# EasyEDA Pro project Athena.eprj, board PCB (continued)
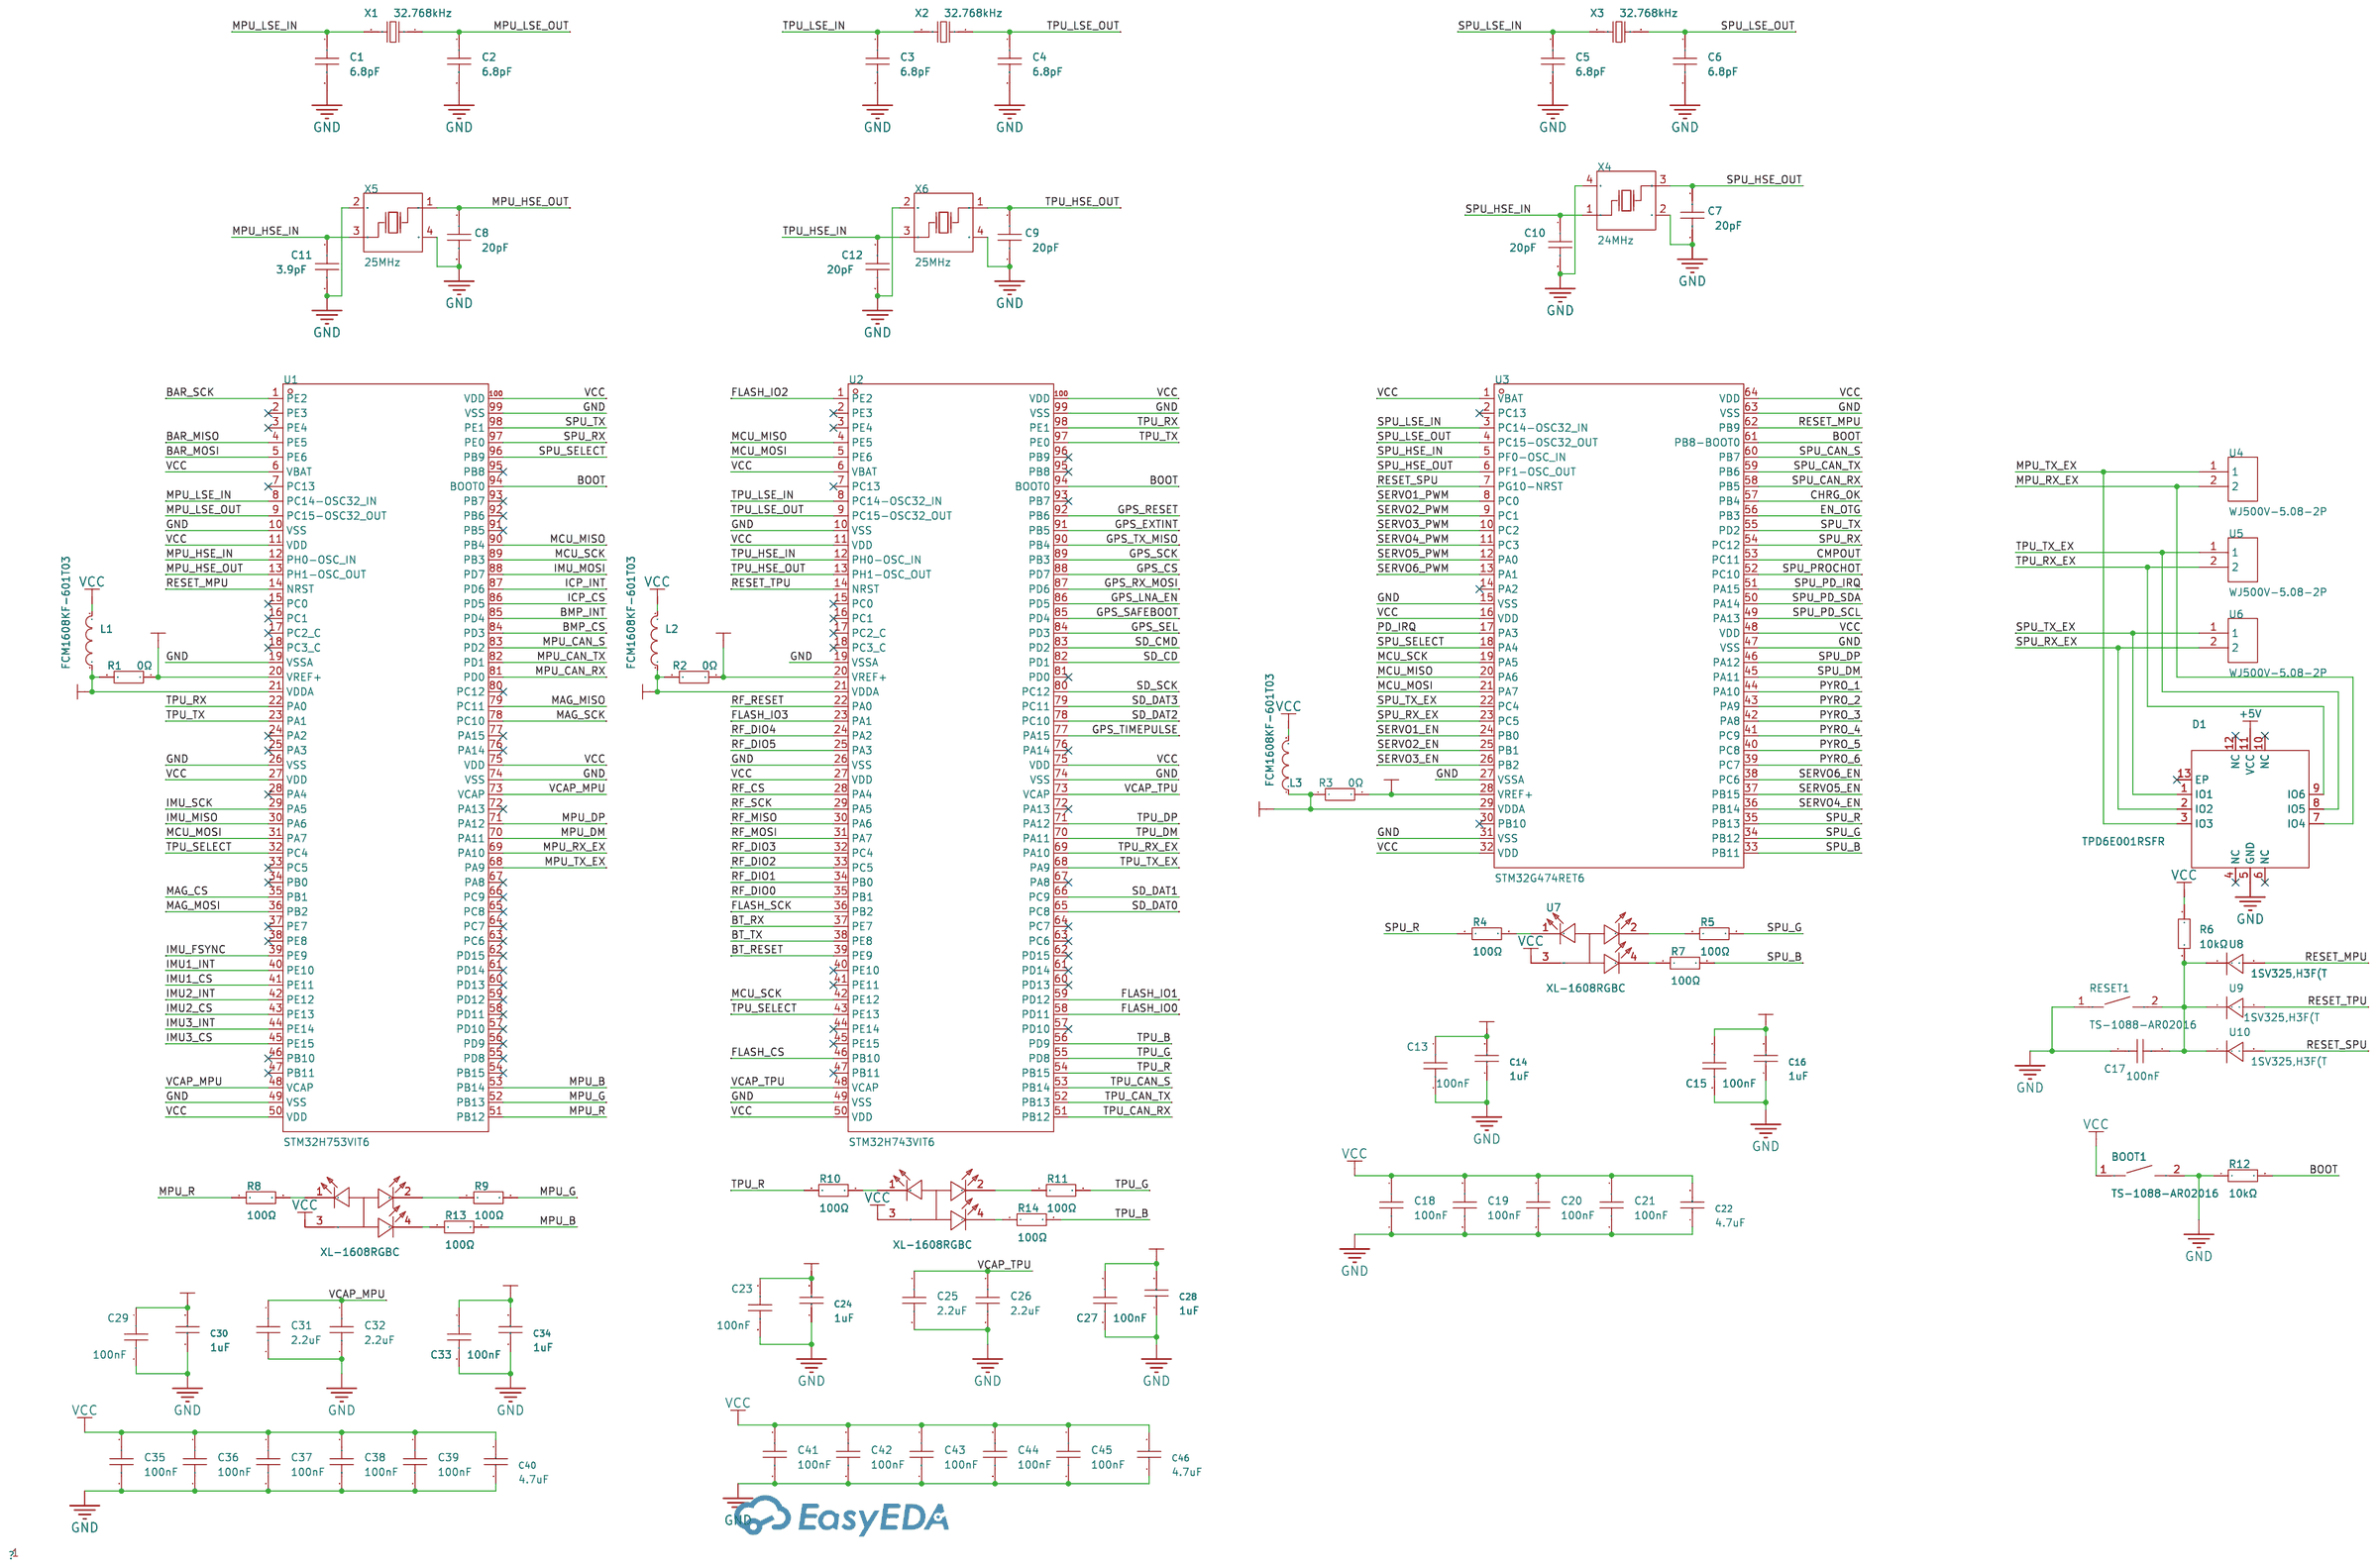
[diagram p0: Processors]
## Footprints (pads in the part's own frame, mm; a bottom-side part is the same pattern mirrored in y, then rotated)
C0402
  rect 0.79x0.54 smd: 1(-0.545,0) 2(0.545,0)
C0603
  rect 0.8x0.9 smd: 1(-0.7,0) 2(0.7,0)
C0805
  rect 1.41x1.35 smd: 1(-1,0) 2(1,0)
C1210
  rect 1.635x2.7 smd: 1(-1.518,0) 2(1.518,0)
CONN-TH_2P-P5.00_WJ500V-5.08-2P
  round 2 hole 1.3: 1(-2.54,0) 2(2.54,0)
CRYSTAL-SMD_4P-L3.2-W2.5-BL
  rect 1.4x1.2 smd: 1(-1.1,-0.85) 2(1.1,-0.85) 3(1.1,0.85) 4(-1.1,0.85)
F0603
  rect 0.806x0.864 smd: 1(-0.753,0) 2(0.753,0)
FC-135R_L3.2-W1.5
  rect 1x1.8 smd: 1(-1.25,0) 2(1.25,0)
GPSM-SMD_24P-L16.0-W12.2-P1.10-TL
  rect 1.8x0.8 smd: 1(-6.1,7) 2(-6.1,5.9) 3(-6.1,4.8) 4(-6.1,3.7) 5(-6.1,2.6) 6(-6.1,1.5) 7(-6.1,0.4) 8(-6.1,-2.6) 9(-6.1,-3.7) 10(-6.1,-4.8) 11(-6.1,-5.9) 12(-6.1,-7) 13(6.1,-7) 14(6.1,-5.9) 15(6.1,-4.8) 16(6.1,-3.7) 17(6.1,-2.6) 18(6.1,0.4) 19(6.1,1.5) 20(6.1,2.6) 21(6.1,3.7) 22(6.1,4.8) 23(6.1,5.9) 24(6.1,7)
HDR-TH_3P-P2.54-V-M
  rect 1.7x1.7 hole 1.1: 1(-2.54,0)
  round 1.7 hole 1.1: 2(0,0) 3(2.54,0)
IND-SMD_L4.4-W4.2
  rect 1.4x2.12 smd: 1(2.028,0) 2(-2.028,0)
IND-SMD_L11.5-W10.0_104CDMCCDS
  rect 3.5x4.1 smd: 1(-5.2,0) 2(5.2,0)
L0402-RD
  rect 0.79x0.54 smd: 1(-0.545,0) 2(0.545,0)
L0603
  rect 0.8x0.864 smd: 1(-0.7,0) 2(0.7,0)
L1206
  rect 1.485x1.728 smd: 1(-1.593,0) 2(1.593,0)
LED0402-RD
  rect 0.636x0.54 smd: 1(-0.538,0) 2(0.538,0)
LED-SMD_4P-L1.6-W0.8-BL
  rect 0.5x0.4 smd: 1(-0.6,0.35) 2(0.6,0.35) 3(-0.6,-0.35) 4(0.6,-0.35)
LGA-10_L2.0-W2.0-P0.50-TL_ICP-20100
  rect 0.3x0.3 smd: 1(-0.78,0.25) 2(-0.78,-0.25) 3(-0.5,-0.78) 4(0,-0.78) 5(0.5,-0.78) 6(0.78,-0.25) 7(0.78,0.25) 8(0.5,0.78) 9(0,0.78) 10(-0.5,0.78)
LGA-12_L2.0-W2.0-P0.50-BL
  rect 0.28x0.5 smd: 1(-0.75,-0.875) 2(-0.25,-0.875) 3(0.25,-0.875) 4(0.75,-0.875) 7(0.75,0.875) 8(0.25,0.875) 9(-0.25,0.875) 10(-0.75,0.875)
  rect 0.5x0.28 smd: 5(0.875,-0.25) 6(0.875,0.25) 11(-0.875,0.25) 12(-0.875,-0.25)
LGA-14_L3.0-W2.5-P0.50-TL
  rect 0.675x0.28 smd: 1(-1.262,0.75) 2(-1.262,0.25) 3(-1.262,-0.25) 4(-1.262,-0.75) 8(1.262,-0.75) 9(1.262,-0.25) 10(1.262,0.25) 11(1.262,0.75)
  rect 0.28x0.675 smd: 5(-0.5,-1.012) 6(0,-1.012) 7(0.5,-1.012) 12(0.5,1.012) 13(0,1.012) 14(-0.5,1.012)
LQFP-32_L7.0-W7.0-P0.80-LS9.0-BL
  oval 0.448x1.684 smd: 1(-2.8,-4.242) 2(-2,-4.242) 3(-1.2,-4.242) 4(-0.4,-4.242) 5(0.4,-4.242) 6(1.2,-4.242) 7(2,-4.242) 8(2.8,-4.242) 17(2.8,4.242) 18(2,4.242) 19(1.2,4.242) 20(0.4,4.242) 21(-0.4,4.242) 22(-1.2,4.242) 23(-2,4.242) 24(-2.8,4.242)
  oval 1.684x0.448 smd: 9(4.242,-2.8) 10(4.242,-2) 11(4.242,-1.2) 12(4.242,-0.4) 13(4.242,0.4) 14(4.242,1.2) 15(4.242,2) 16(4.242,2.8) 25(-4.242,2.8) 26(-4.242,2) 27(-4.242,1.2) 28(-4.242,0.4) 29(-4.242,-0.4) 30(-4.242,-1.2) 31(-4.242,-2) 32(-4.242,-2.8)
LQFP-64_L10.0-W10.0-P0.50-LS12.0-BL
  oval 0.3x2 smd: 1(-3.75,-5.75) 2(-3.25,-5.75) 3(-2.75,-5.75) 4(-2.25,-5.75) 5(-1.75,-5.75) 6(-1.25,-5.75) 7(-0.75,-5.75) 8(-0.25,-5.75) 9(0.25,-5.75) 10(0.75,-5.75) 11(1.25,-5.75) 12(1.75,-5.75) 13(2.25,-5.75) 14(2.75,-5.75) 15(3.25,-5.75) 16(3.75,-5.75) 33(3.75,5.75) 34(3.25,5.75) 35(2.75,5.75) 36(2.25,5.75) 37(1.75,5.75) 38(1.25,5.75) 39(0.75,5.75) 40(0.25,5.75) 41(-0.25,5.75) 42(-0.75,5.75) 43(-1.25,5.75) 44(-1.75,5.75) 45(-2.25,5.75) 46(-2.75,5.75) 47(-3.25,5.75) 48(-3.75,5.75)
  oval 2x0.3 smd: 17(5.75,-3.75) 18(5.75,-3.25) 19(5.75,-2.75) 20(5.75,-2.25) 21(5.75,-1.75) 22(5.75,-1.25) 23(5.75,-0.75) 24(5.75,-0.25) 25(5.75,0.25) 26(5.75,0.75) 27(5.75,1.25) 28(5.75,1.75) 29(5.75,2.25) 30(5.75,2.75) 31(5.75,3.25) 32(5.75,3.75) 49(-5.75,3.75) 50(-5.75,3.25) 51(-5.75,2.75) 52(-5.75,2.25) 53(-5.75,1.75) 54(-5.75,1.25) 55(-5.75,0.75) 56(-5.75,0.25) 57(-5.75,-0.25) 58(-5.75,-0.75) 59(-5.75,-1.25) 60(-5.75,-1.75) 61(-5.75,-2.25) 62(-5.75,-2.75) 63(-5.75,-3.25) 64(-5.75,-3.75)
LQFP-100_L14.0-W14.0-P0.50-LS16.0-BL
  oval 0.3x1.6 smd: 1(-6,-7.55) 2(-5.5,-7.55) 3(-5,-7.55) 4(-4.5,-7.55) 5(-4,-7.55) 6(-3.5,-7.55) 7(-3,-7.55) 8(-2.5,-7.55) 9(-2,-7.55) 10(-1.5,-7.55) 11(-1,-7.55) 12(-0.5,-7.55) 13(0,-7.55) 14(0.5,-7.55) 15(1,-7.55) 16(1.5,-7.55) 17(2,-7.55) 18(2.5,-7.55) 19(3,-7.55) 20(3.5,-7.55) 21(4,-7.55) 22(4.5,-7.55) 23(5,-7.55) 24(5.5,-7.55) 25(6,-7.55) 51(6,7.55) 52(5.5,7.55) 53(5,7.55) 54(4.5,7.55) 55(4,7.55) 56(3.5,7.55) 57(3,7.55) 58(2.5,7.55) 59(2,7.55) 60(1.5,7.55) 61(1,7.55) 62(0.5,7.55) 63(0,7.55) 64(-0.5,7.55) 65(-1,7.55) 66(-1.5,7.55) 67(-2,7.55) 68(-2.5,7.55) 69(-3,7.55) 70(-3.5,7.55) 71(-4,7.55) 72(-4.5,7.55) 73(-5,7.55) 74(-5.5,7.55) 75(-6,7.55)
  oval 1.6x0.3 smd: 26(7.55,-6) 27(7.55,-5.5) 28(7.55,-5) 29(7.55,-4.5) 30(7.55,-4) 31(7.55,-3.5) 32(7.55,-3) 33(7.55,-2.5) 34(7.55,-2) 35(7.55,-1.5) 36(7.55,-1) 37(7.55,-0.5) 38(7.55,0) 39(7.55,0.5) 40(7.55,1) 41(7.55,1.5) 42(7.55,2) 43(7.55,2.5) 44(7.55,3) 45(7.55,3.5) 46(7.55,4) 47(7.55,4.5) 48(7.55,5) 49(7.55,5.5) 50(7.55,6) 76(-7.55,6) 77(-7.55,5.5) 78(-7.55,5) 79(-7.55,4.5) 80(-7.55,4) 81(-7.55,3.5) 82(-7.55,3) 83(-7.55,2.5) 84(-7.55,2) 85(-7.55,1.5) 86(-7.55,1) 87(-7.55,0.5) 88(-7.55,0) 89(-7.55,-0.5) 90(-7.55,-1) 91(-7.55,-1.5) 92(-7.55,-2) 93(-7.55,-2.5) 94(-7.55,-3) 95(-7.55,-3.5) 96(-7.55,-4) 97(-7.55,-4.5) 98(-7.55,-5) 99(-7.55,-5.5) 100(-7.55,-6)
OSC-SMD_4P-L7.0-W5.0-BL_ABMM
  rect 1.9x1.4 smd: 1(-3.15,-1.27) 2(3.15,-1.27) 3(3.15,1.27) 4(-3.15,1.27)
PICOSTAR-3_L0.7-W0.6-P0.35-TL
  rect 0.3x0.2 smd: 1(-0.225,0.202) 2(-0.225,-0.202)
  rect 0.2x0.6 smd: 3(0.225,-0.002)
PICOSTAR-3_L0.7-W0.6-P0.40-TL
  rect 0.25x0.2 smd: 1(-0.2,0.2) 2(-0.2,-0.2)
  rect 0.15x0.5 smd: 3(0.2,0)
POWERVDFN-8_L6.0-W5.0-P1.27-BL
  rect 0.8x1.321 smd: 1(-1.905,-3.026) 2(-0.635,-3.026) 3(0.635,-3.026) 4(1.905,-3.026) 5(1.905,3.026) 6(0.635,3.026) 7(-0.635,3.026) 8(-1.905,3.026)
  rect 4.6x3.6 smd: 9(0,0.65)
QFN-12_L4.0-W4.0-P0.80-BL-EP1.7
  rect 0.35x0.8 smd: 1(-0.8,-1.9) 2(0,-1.9) 3(0.8,-1.9) 7(0.8,1.9) 8(0,1.9) 9(-0.8,1.9)
  rect 0.8x0.35 smd: 4(1.9,-0.8) 5(1.9,0) 6(1.9,0.8) 10(-1.9,0.8) 11(-1.9,0) 12(-1.9,-0.8)
  rect 1.7x1.7 smd: 13(0,0)
QFN-32_L4.0-W4.0-P0.40-TL-EP2.8
  oval 0.7x0.2 smd: 1(-2.057,1.4) 2(-2.057,1) 3(-2.057,0.6) 4(-2.057,0.2) 5(-2.057,-0.2) 6(-2.057,-0.6) 7(-2.057,-1) 8(-2.057,-1.4) 17(2.057,-1.4) 18(2.057,-1) 19(2.057,-0.6) 20(2.057,-0.2) 21(2.057,0.2) 22(2.057,0.6) 23(2.057,1) 24(2.057,1.4)
  oval 0.2x0.7 smd: 9(-1.4,-2.057) 10(-1,-2.057) 11(-0.6,-2.057) 12(-0.2,-2.057) 13(0.2,-2.057) 14(0.6,-2.057) 15(1,-2.057) 16(1.4,-2.057) 25(1.4,2.057) 26(1,2.057) 27(0.6,2.057) 28(0.2,2.057) 29(-0.2,2.057) 30(-0.6,2.057) 31(-1,2.057) 32(-1.4,2.057)
  rect 2.8x2.8 smd: 33(0,-0.001)
QFN-38_L6.0-W4.0-P0.40-TL-EP_TI_REF0038A
  rect 0.6x0.2 smd: 1(-2.9,1) 2(-2.9,0.6) 3(-2.9,0.2) 4(-2.9,-0.2) 5(-2.9,-0.6) 6(-2.9,-1)
  rect 0.2x0.6 smd: 7(-2.4,-1.9) 8(-2,-1.9) 9(-1.6,-1.9) 10(-1.2,-1.9) 11(-0.8,-1.9) 12(-0.4,-1.9) 13(0,-1.9) 14(0.4,-1.9) 15(0.8,-1.9) 16(1.2,-1.9) 17(1.6,-1.9) 18(2,-1.9) 19(2.4,-1.9) 26(2.4,1.9) 27(2,1.9) 28(1.6,1.9) 29(1.2,1.9) 30(0.8,1.9) 31(0.4,1.9) 36(-1.6,1.9) 37(-2,1.9) 38(-2.4,1.9)
  custom 0.6x1.12 smd: 21(2.9,-0.675) 24(2.9,0.675)
  custom 0.6x0.6 smd: 32(-0.2,1.9) 34(-1,1.9)
  rect 2.65x2.65 smd: 39(-0.965,0)
  rect 1.53x2.65 smd: 40(1.56,0)
R0402
  rect 0.566x0.54 smd: 1(-0.433,0) 2(0.433,0)
R0603
  rect 0.806x0.864 smd: 1(-0.753,0) 2(0.753,0)
R1206
  rect 1.208x1.701 smd: 1(-1.479,0) 2(1.479,0)
SENSORM-SMD_BMP388
  rect 0.3x0.5 smd: 1(0.25,0.871) 2(-0.25,0.871) 6(-0.25,-0.871) 7(0.25,-0.871)
  rect 0.5x0.3 smd: 3(-0.869,0.5) 4(-0.869,0) 5(-0.869,-0.5) 8(0.869,-0.5) 9(0.869,0) 10(0.869,0.5)
SMA-TH_BWSMA-KWE-Z001
  round 2.2 hole 1.6: 1(-2.55,-2.55) 2(-2.55,2.55) 3(2.55,2.55) 4(2.55,-2.55)
  round 2 hole 1.3: 5(0,0)
SOD-523_L1.2-W0.8-LS1.6-RD
  rect 0.6x0.36 smd: 1(-0.65,0) 2(0.65,0)
SOIC-8_L4.9-W3.9-P1.27-LS6.0-BL
  oval 0.588x2.045 smd: 1(-1.905,-2.772) 2(-0.635,-2.772) 3(0.635,-2.772) 4(1.905,-2.772) 5(1.905,2.772) 6(0.635,2.772) 7(-0.635,2.772) 8(-1.905,2.772)
SOT-23-3_L2.9-W1.3-P1.90-LS2.4-BR
  rect 1.25x0.7 smd: 1(1,-0.95) 2(1,0.95) 3(-1,0)
SOT-23-3_L2.9-W1.6-P1.90-LS2.8-BR
  rect 1.07x0.6 smd: 1(1.235,-0.95) 2(1.235,0.95) 3(-1.235,0)
SOT-23-3_L3.0-W1.7-P0.95-LS2.9-BR
  rect 1.038x0.532 smd: 1(1.101,-0.95) 2(1.101,0.95) 3(-1.101,0)
SOT-23-6_L2.9-W1.6-P0.95-LS2.8-BL
  rect 0.532x1.072 smd: 1(-0.95,-1.149) 2(0,-1.149) 3(0.95,-1.149) 4(0.95,1.149) 5(0,1.149) 6(-0.95,1.149)
SW-SMD_L3.9-W3.0-P4.45
  rect 1.23x1.36 smd: 1(-2.185,0) 2(2.185,0)
TF-SMD_TF-PUSH
  rect 0.7x1.6 smd: 1(2.25,5.3) 2(1.15,5.3) 3(0.05,5.3) 4(-1.05,5.3) 5(-2.15,5.3) 6(-3.25,5.3) 7(-4.35,5.3) 8(-5.45,5.3) CD(-6.55,5.3)
  rect 1.2x1.5 smd: 10(-7.75,4.3)
  rect 1.2x2.2 smd: 11(-7.75,-5.3) 12(7.75,-5.3)
  rect 1.6x1.5 smd: 13(6.85,4.3)
USB-C-SMD_TYPE-C-6PIN-2MD-073
  rect 0.55x1.1 smd: 1(-3.2,2.375) 2(-2.4,2.375) 11(2.4,2.375) 12(3.2,2.375)
  rect 0.3x1.1 smd: 3(-1.75,2.375) 4(-1.25,2.375) 5(-0.75,2.375) 6(-0.25,2.375) 7(0.25,2.375) 8(0.75,2.375) 9(1.25,2.375) 10(1.75,2.375)
  oval 1.1x2 hole 0.6x1.5: 13(-4.325,1.825) 14(4.325,1.825)
  oval 1.2x1.8 hole 0.6x1.2: 13(-4.325,-2.375) 14(4.325,-2.375)
VQFN-20_L4.5-W3.5-P0.50-BL-EP
  rect 0.85x0.28 smd: 1(-2.25,-0.752) 10(2.25,-0.752) 11(2.25,0.748) 20(-2.25,0.75)
  rect 0.28x0.85 smd: 2(-1.748,-1.75) 3(-1.248,-1.75) 4(-0.749,-1.75) 5(-0.248,-1.75) 6(0.252,-1.75) 7(0.751,-1.75) 8(1.252,-1.75) 9(1.752,-1.75) 12(1.752,1.75) 13(1.252,1.75) 14(0.75,1.748) 15(0.25,1.748) 16(-0.25,1.748) 17(-0.75,1.748) 18(-1.25,1.748) 19(-1.75,1.748)
  rect 2.7x1.7 smd: 21(0,-0.002)
VSON-CLIP-8_L3.3-W3.3-P0.65-BL
  rect 0.4x0.7 smd: 1(-0.975,-1.6) 2(-0.325,-1.6) 3(0.325,-1.6) 4(0.975,-1.6) 5(0.975,1.6) 6(0.325,1.6) 7(-0.325,1.6) 8(-0.975,1.6)
  rect 2.45x1.9 smd: 8(0,0.44)
VSONP-8_L3.1-W3.1-P0.65-LS3.5-BL
  rect 0.45x0.68 smd: 1(-0.988,-1.498) 2(-0.338,-1.498) 3(0.312,-1.498) 4(0.963,-1.498)
  rect 0.5x0.6 smd: 5(0.988,1.498) 6(0.338,1.498) 7(-0.312,1.498) 8(-0.963,1.498)
  rect 2.65x2 smd: 9(0.013,0.406)
WIRELM-SMD-16_L14.5-W12.5-P1.50-DA14531MOD
  rect 2.6x1.2 smd: J1(-6.088,4.044) J2(-6.088,2.544) J3(-6.088,1.044) J4(-6.088,-0.457) J5(-6.088,-1.956) J12(6.088,-1.956) J13(6.088,-0.457) J14(6.088,1.044) J15(6.088,2.544) J16(6.088,4.044)
  rect 1.2x2.6 smd: J6(-3.75,-4.043) J7(-2.25,-4.043) J8(-0.75,-4.043) J9(0.75,-4.043) J10(2.25,-4.043) J11(3.75,-4.043)
WIRELM-SMD_RA-02-BL
  rect 1.4x2.2 smd: 1(-7,-8) 2(-5,-8) 3(-3,-8) 4(-1,-8) 5(1,-8) 6(3,-8) 7(5,-8) 8(7,-8) 9(7,8) 10(5,8) 11(3,8) 12(1,8) 13(-1,8) 14(-3,8) 15(-4.998,8) 16(-7,8)
WQFN-20_L3.0-W3.0-P0.40-BL-EP1.7
  rect 0.2x0.8 smd: 1(-0.8,-1.5) 2(-0.4,-1.5) 3(0,-1.5) 4(0.4,-1.5) 5(0.8,-1.5) 11(0.8,1.5) 12(0.4,1.5) 13(0,1.5) 14(-0.4,1.5) 15(-0.8,1.5)
  rect 0.8x0.2 smd: 6(1.5,-0.8) 7(1.5,-0.4) 8(1.5,0) 9(1.5,0.4) 10(1.5,0.799) 16(-1.5,0.8) 17(-1.5,0.4) 18(-1.5,0) 19(-1.5,-0.4) 20(-1.5,-0.8)
  rect 1.7x1.7 smd: 21(0,0)
WSON-8_L8.0-W6.10-P1.27-BL-EP
  oval 0.56x1.4 smd: 1(-1.905,-4.027) 2(-0.635,-4.027) 3(0.635,-4.027) 4(1.905,-4.027) 5(1.905,4.027) 6(0.635,4.027) 7(-0.635,4.027) 8(-1.905,4.027)
  rect 4.3x3.4 smd: 9(0,0)

## Nets
As in the schematic, except:
GND: BOOT1.2 C1.2 C2.2 C3.2 C4.2 C5.2 C6.2 C7.2 C8.2 C9.2 C10.2 C11.2 C12.2 C13.2 C14.1 C15.2 C16.1 C17.2 C18.2 C19.2 C20.2 C21.2 C22.1 C23.2 C24.1 C25.2 C26.2 C27.2 C28.1 C29.2 C30.1 C31.2 C32.2 C33.2 C34.1 C35.2 C36.2 C37.2 C38.2 C39.2 C40.1 C41.2 C42.2 C43.2 C44.2 C45.2 C46.1 C47.1 C48.1 C50.1 C51.1 C52.1 C54.1 C55.1 C59.2 C60.2 C61.2 C62.2 C69.2 C81.1 C82.1 C83.1 C84.2 C86.2 C87.2 C88.2 C89.2 C90.2 C91.2 C92.2 C93.2 C94.2 C95.2 C96.2 C97.2 C98.2 C99.2 C100.2 C101.2 C102.2 C103.2 C104.2 C105.2 C106.2 C107.2 C108.2 C109.2 C110.2 C111.2 C112.2 C113.2 C114.2 C115.2 C116.2 C117.2 C118.2 C119.2 C120.2 C121.2 C122.2 C123.2 C124.2 C125.1 C126.1 C127.2 C128.2 C129.1 C130.2 C131.2 C132.1 C133.2 C134.2 C135.2 C136.1 C137.2 C138.2 C139.2 CARD1.6 CARD1.10 CARD1.11 CARD1.12 CARD1.13 D1.5 D2.8 D2.13 D2.18 D2.21 D3.3 F1.2 F2.2 F3.2 F4.2 F5.2 F6.2 FLASH1.4 FLASH1.9 GPS1.7 GPS1.10 GPS1.12 GPS1.13 GPS1.24 IMU1.6 IMU2.6 IMU3.6 MAG1.3 Q2.1 Q2.2 Q2.3 Q5.2 Q6.2 R12.1 R16.1 R17.1 R23.1 R30.1 R41.1 R47.2 R51.2 R52.2 R53.1 R65.1 R86.1 R87.1 R89.1 R91.1 R93.1 R94.1 RESET1.1 RF1.1 RF1.2 RF1.3 RF1.4 S1.1 S2.1 S3.1 S4.1 S5.1 S6.1 U1.10 U1.19 U1.26 U1.49 U1.74 U1.99 U2.10 U2.19 U2.26 U2.49 U2.74 U2.99 U3.15 U3.27 U3.31 U3.47 U3.63 U13.6 U13.12 U13.21 U15.2 U17.1 U18.2 U19.14 U19.33 U20.11 U20.12 U20.14 U20.39 U21.J2 U21.J3 U21.J4 U21.J6 U21.J11 U22.2 U23.7 U23.21 U23.22 U23.23 U23.24 U23.28 U23.31 U23.32 U24.1 U24.2 U24.9 U24.16 U25.2 U26.2 U27.3 U27.8 U27.9 U28.6 U28.8 USB1.1 USB1.12 USB1.13 USB1.14 X4.2 X4.4 X5.2 X5.4 X6.2 X6.4 X7.2 X7.4

Pads without a net: D1 4 6 10 12 13; D2 16 17; GPS1 5 6 15 16 17; IMU1 2 3 7 10 11; IMU2 2 3 7 10 11; IMU3 2 3 7 10 11; MAG1 8 9; U1 2 3 7 15 16 17 18 24 25 28 33 34 37 38 46 47 54 55 56 57 58 59 60 61 62 63 64 65 66 67 72 76 77 80 91 92 93 95; U2 2 3 7 15 16 17 18 40 41 44 45 47 57 60 61 62 63 64 67 72 76 81 93 95 96; U3 2 14 30; U13 7 9 15 16; U20 5 6 7 13 19 36 37; U21 J1 J5 J8 J9 J13 J15 J16; U23 5 9 13 17; U28 2 11 12

## Via types
v1: diameter 0.4, hole 0.2, Top Layer to Bottom Layer, 1561 vias
v2: diameter 0.4, hole 0.3, Top Layer to Bottom Layer, 19 vias
v3: diameter 0.6, hole 0.4, Top Layer to Bottom Layer, 6 vias

## Routing (per net, layer and track width the routed paths; a pad name or vN(x,y) marks a point on that pad's centre or on a via; arc(x,y) is an arc through that point)
5V_COMP: length 5.8
  Bottom Layer w0.2: 23.5,24.56 26.94,24.56 27.12,24.39 27.12,24.29 27.31,24.48 C57.1
5V_FB: length 14.3
  Bottom Layer w0.2: U13.5 24.29,24.06 26.27,22.08 29.32,22.08 30.32,23.08 R24.2
  Bottom Layer w0.4: R24.2 30.52,24.09 C57.2 30.44,24.78 30.44,26.96 C53.2 30.43,28.17 R18.1
5V_VCC: length 12.7
  SIGNAL w0.2: v1(25.6,21.7) 20.15,21.7 v1(18.77,23.08)
  Bottom Layer w0.2: v1(25.6,21.7) 26.25,21.05 R20.1 R21.1 ; U13.14 18.72,23.06 ; 18.72,23.06 17.53,23.06 C55.2 ; 18.72,23.06 18.74,23.08 v1(18.77,23.08)
+5V: length 142.9
  Top Layer w0.4: v2(47.25,12.95) Q15.2 ; v2(29.45,57.05) 29.6,56.9 C121.1 29.6,54.4 U26.3 ; v2(50.55,12.95) Q16.2 ; Q17.2 53.8,10.95 v2(53.8,8.75) ; v2(49.35,57.05) 49.41,56.99 C119.1 49.41,54.4 U25.3 ; U22.3 39.41,54.4 C112.1 39.41,57.04 v2(39.4,57.05)
  POWER w0.4: v1(28.75,30.15) 24.93,30.15 24.92,30.16 ; 24.92,30.16 24.92,52.52 v2(29.45,57.05) ; 24.92,30.16 v2(24.92,16.3) ; v2(29.45,57.05) 20.15,66.35 v2(20.15,70.1) ; v2(29.45,57.05) v2(39.4,57.05) v2(49.35,57.05)
  GND2 w0.4: v2(53.8,8.75) 53.8,12.85 53.7,12.95 v2(50.55,12.95) v2(47.25,12.95) 41.12,12.95 39.27,11.1 v2(22.95,11.1) v2(22.2,11.1) v2(21.46,11.1)
  Bottom Layer w0.4: v2(20.15,70.1) 19.35,70.9 D1.11 ; v1(28.75,30.15) 29.95,30.15 R18.2 31.75,30.03 R19.2
  vias: v1(12,14.9) v1(12.75,14.9) v1(13.5,14.9) v1(13.5,11.8) v1(14.25,14.9) v1(14.25,11.8) v1(15,14.9) v1(15,11.8) v1(15.75,14.9) v1(15.75,11.8) v1(16.5,14.9) v1(16.5,11.8) v1(17.25,14.9) v1(17.25,11.8) v1(18,14.9) v1(18,11.8) v1(18.75,14.9) v1(18.75,11.8) v1(19.35,15.25) v1(19.5,11.8) v1(19.88,15.78) v1(20.25,11.8) v1(20.42,16.3) v1(21,11.8) v1(21.17,16.3) v1(21.92,16.3) v1(22.67,16.3) v1(23.42,16.3) v1(24.17,16.3) v1(25.67,16.3) v1(26.42,16.3) v1(27.17,16.3) v1(27.92,16.3) v1(28.67,16.3) v1(48,37.3) v1(48.9,37.3) v1(49.8,37.3) v1(50.7,37.3) v1(51.7,37.3) v1(52.7,37.3) v1(53.6,37.3) v1(56.12,37.7) v1(56.39,37.2) v1(56.63,37.7) v1(56.89,37.2) v1(57.2,37.7) v1(57.4,37.2) v1(57.7,37.7)
AGND: length 17.8
  GND2 w0.4: v1(32.5,45.4) 32.5,46.9 31.05,48.35 25.87,48.35 v1(21.8,52.43)
  Bottom Layer w0.2: U19.27 32.66,45.24 v1(32.5,45.4) C85.2
  Bottom Layer w0.4: v1(21.8,52.43) 22.94,52.43 Q11.1
GND: length 45.4
  Top Layer w0.2: 6.49,47.24 D3.3 ; 6.49,47.24 C123.2 ; 6.49,47.24 5.52,48.22 ; U2.99 30.93,81.42 31.41,80.94 32.14,80.94 32.6,81.4 v1(32.95,81.4) ; 51.27,84.63 50.45,85.45
  Bottom Layer w0.2: U13.12 20.26,22.06 v1(21.1,22.9) ; 62.85,37.02 62.05,37.02 ; 62.85,37.02 62.89,37.02 63.01,36.9 63.37,36.9 U20.11 ; 62.85,37.02 U20.12 ; 62.05,37.02 62.86,36.21 62.86,35.85 63.01,35.7 63.37,35.7 U20.14 ; 62.05,37.02 v1(61.51,37.02) ; v1(64.85,83.45) 64.85,83.46 C22.1 ; R30.1 11.4,62.34 11.4,63.25 ; U19.14 32.7,40.26 32.7,41.72 v1(33.26,42.27) ; C137.2 41.74,81.36 41.51,81.59 U28.6 40.82,81.6 40.5,81.6 40.2,81.3 40.2,80.97 U28.8 ; C96.2 29.75,35.43 C92.2 ; 24.91,86.67 C28.1 22.33,86.67 C24.1 22.26,86.67 C23.2 ; D2.8 40.25,12.65 40.25,12.2 40.69,11.75 v1(40.69,11.64) 40.8,11.64 41.2,11.25 41.65,11.25 D2.13 ; v1(22.05,22.9) 22.71,23.56 23.32,23.56 ; C27.2 24.91,86.28 26.42,84.77 27.01,84.77 C44.2 28.59,83.18 C45.2 ; BOOT1.2 R12.1 ; C97.2 27.47,35.43 C93.2 ; v1(39.7,10.75) 40.2,10.25 D2.18 ; 39.3,41.29 40.54,41.29 v1(40.6,41.35) ; C21.2 v1(54.85,80.1)
  vias: v1(2.3,138.3) v1(2.3,136.3) v1(2.3,134.3) v1(2.3,132.3) v1(2.3,130.3) v1(2.3,128.3) v1(2.3,126.3) v1(2.3,124.3) v1(2.3,122.3) v1(2.3,120.3) v1(2.3,118.3) v1(2.3,116.3) v1(2.3,114.3) v1(2.3,112.3) v1(2.3,110.3) v1(2.3,108.3) v1(2.3,106.3) v1(2.3,104.3) v1(2.3,102.3) v1(2.3,100.3) v1(2.3,98.3) v1(2.3,96.3) v1(2.3,92.3) v1(2.3,90.3) v1(2.3,88.3) v1(2.3,86.3) v1(2.3,84.3) v1(2.3,82.3) v1(2.3,80.3) v1(2.3,78.3) v1(2.3,76.3) v1(2.3,74.3) v1(2.3,72.3) v1(2.3,70.3) v1(2.3,68.3) v1(2.3,66.3) v1(2.3,64.3) v1(2.3,62.3) v1(2.3,60.3) v1(2.3,58.3) v1(2.3,56.3) v1(2.3,54.3) v1(2.3,52.3) v1(2.3,50.3) v1(2.3,48.3) v1(2.3,46.3) v1(2.3,44.3) v1(2.3,42.3) v1(2.3,40.3) v1(2.3,38.3) v1(2.3,36.3) v1(2.3,34.3) v1(2.3,32.3) v1(2.3,30.3) v1(2.3,28.3) v1(2.3,26.3) v1(2.3,24.3) v1(2.3,22.3) v1(2.3,20.3) v1(2.3,18.3) v1(2.3,16.3) v1(2.3,14.3) v1(2.3,12.3) v1(2.3,10.3) v1(2.3,8.3) v1(2.3,6.3) v1(2.3,4.3) v1(2.3,2.3) v1(4.3,138.3) v1(4.3,132.3) v1(4.3,130.3) v1(4.3,128.3) v1(4.3,126.3) v1(4.3,124.3) v1(4.3,122.3) v1(4.3,120.3) v1(4.3,118.3) v1(4.3,114.3) v1(4.3,110.3) v1(4.3,108.3) v1(4.3,106.3) v1(4.3,102.3) v1(4.3,98.3) v1(4.3,92.3) v1(4.3,90.3) v1(4.3,88.3) v1(4.3,86.3) v1(4.3,84.3) v1(4.3,82.3) v1(4.3,80.3) v1(4.3,78.3) v1(4.3,76.3) v1(4.3,74.3) v1(4.3,72.3) v1(4.3,70.3) v1(4.3,68.3) v1(4.3,66.3) v1(4.3,64.3) v1(4.3,62.3) v1(4.3,60.3) v1(4.3,58.3) v1(4.3,56.3) v1(4.3,44.3) v1(4.3,42.3) v1(4.3,40.3) v1(4.3,38.3) v1(4.3,36.3) v1(4.3,34.3) v1(4.3,32.3) v1(4.3,26.3) v1(4.3,20.3) v1(4.3,18.3) v1(4.3,16.3) v1(4.3,14.3) v1(4.3,12.3) v1(4.3,10.3) v1(4.3,8.3) v1(4.3,2.3) v1(5.35,50.6) v1(5.5,47.15) v1(6.3,138.3) v1(6.3,132.3) v1(6.3,130.3) v1(6.3,128.3) v1(6.3,126.3) v1(6.3,124.3) v1(6.3,122.3) v1(6.3,120.3) v1(6.3,118.3) v1(6.3,116.3) v1(6.3,114.3) v1(6.3,112.3) v1(6.3,110.3) v1(6.3,108.3) v1(6.3,106.3) v1(6.3,104.3) v1(6.3,102.3) v1(6.3,100.3) v1(6.3,92.3) v1(6.3,90.3) v1(6.3,84.3) v1(6.3,78.3) v1(6.3,74.3) v1(6.3,72.3) v1(6.3,68.3) v1(6.3,66.3) v1(6.3,62.3) v1(6.3,58.3) v1(6.3,56.3) v1(6.3,38.3) v1(6.3,32.3) v1(6.3,26.3) v1(6.3,20.3) v1(6.3,16.3) v1(6.3,14.3) v1(6.3,10.3) v1(6.3,8.3) v1(6.3,2.3) v1(6.49,45.64) v1(7.5,47.15) v1(8.3,138.3) v1(8.3,136.3) v1(8.3,134.3) v1(8.3,132.3) v1(8.3,130.3) v1(8.3,128.3) v1(8.3,126.3) v1(8.3,96.3) v1(8.3,92.3) v1(8.3,90.3) v1(8.3,88.3) v1(8.3,86.3) v1(8.3,58.3) v1(8.3,56.3) v1(8.3,26.3) v1(8.3,6.3) v1(8.3,4.3) v1(8.3,2.3) v1(9.2,125.05) v1(9.5,123.3) v1(10.25,118.3) v1(10.25,116.31) v1(10.25,114.3) v1(10.25,112.28) v1(10.25,110.31) v1(10.25,108.28) v1(10.25,106.3) v1(10.15,104.3) v1(10.3,138.3) v1(10.3,136.3) v1(10.3,94.3) v1(10.3,92.3) v1(10.3,90.3) v1(10.3,88.3) v1(10.3,86.3) v1(10.3,84.3) v1(10.3,82.6) v1(10.3,56.3) v1(10.3,28.3) v1(10.3,26.3) v1(10.3,20.3) v1(10.3,18.3) v1(10.3,16.3) v1(10.3,14.3) v1(10.3,12.3) v1(10.3,10.3) v1(10.3,8.3) v1(10.3,4.3) v1(10.3,2.3) v1(12.3,138.3) v1(12.3,136.3) v1(12.3,118.3) v1(12.3,116.3) v1(12.3,114.3) v1(12.3,112.3) v1(12.3,110.3) v1(12.3,108.3) v1(12.3,106.3) v1(12.3,104.3) v1(12.3,67.75) v1(12.3,56.3) v1(12.3,28.3) v1(12.3,22.3) v1(12.3,20.3) v1(12.3,18.3) v1(12.3,8.3) v1(12.3,6.3) v1(12.3,2.3) v1(14.3,138.3) v1(14.3,136.3) v1(14.3,134.3) v1(14.3,132.3) v1(14.3,130.3) v1(14.3,128.3) v1(14.3,126.3) v1(14.3,124.3) v1(14.3,122.3) v1(14.3,120.3) v1(14.3,118.3) v1(14.3,114.3) v1(14.3,112.3) v1(14.3,98.3) v1(14.3,96.3) v1(14.3,65.75) v1(14.3,56.3) v1(14.3,48.3) v1(14.3,46.3) v1(14.3,44.3) v1(14.3,42.3) v1(14.3,40.3) v1(14.3,24.3) v1(14.3,22.3) v1(14.3,20.3) v1(14.3,8.3) v1(14.3,4.3) v1(16.3,138.3) v1(16.3,136.3) v1(16.3,134.3) v1(16.3,132.3) v1(16.3,130.3) v1(16.3,128.3) v1(16.3,126.3) v1(16.3,124.3) v1(16.3,122.3) v1(16.3,120.3) v1(16.3,118.3) v1(16.3,116.3) v1(16.3,114.3) v1(16.3,112.3) v1(16.3,65.75) v1(16.3,63.75) v1(16.3,48.3) v1(16.3,46.3) v1(16.3,44.3) v1(16.3,26.3) v1(16.3,22.3) v1(16.3,20.3) v1(16.3,8.3) v1(16.3,6.3) v1(16.3,4.3) v1(18.3,138.3) v1(18.3,136.3) v1(18.3,134.3) v1(18.3,132.3) v1(18.3,130.3) v1(18.3,128.3) v1(18.3,126.3) v1(18.3,78.3) v1(18.3,65.75) v1(18.3,63.75) v1(18.3,48.3) v1(18.3,46.3) v1(18.3,44.3) v1(18.3,8.3) v1(18.3,4.3) v1(18.92,58.05) v1(19.92,58.05) v1(20.3,138.3) v1(20.3,136.3) v1(20.3,134.3) v1(20.3,132.3) v1(20.3,130.3) v1(20.3,88.3) v1(20.3,86.3) v1(20.3,84.3) v1(20.3,82.3) v1(20.3,71.99) v1(20.3,48.3) v1(20.3,46.3) v1(20.3,44.3) v1(20.3,26.15) v1(20.3,8.3) v1(20.3,4.3) v1(20.92,58.05) v1(21.1,24.8) v1(21.57,23.81) v1(21.69,125.82) v1(21.69,123.82) v1(21.69,121.82) v1(22.03,24.8) v1(22.2,28.8) v1(22.3,138.3) v1(22.3,136.3) v1(22.3,134.3) v1(22.3,132.3) v1(22.3,84.3) v1(22.3,82.3) v1(22.3,80.3) v1(22.3,71.99) v1(22.3,69.99) v1(22.3,40.3) v1(23.69,125.82) v1(24.3,138.3) v1(24.3,136.3) v1(24.3,134.3) v1(24.35,129.7) v1(24.33,127.66) v1(24.3,69.99) v1(24.92,58.05) v1(25.05,123.5) v1(26.3,138.3) v1(26.3,136.3) v1(26.3,118.3) v1(26.3,116.3) v1(26.3,112.3) v1(26.3,71.99) v1(26.3,46.3) v1(26.3,44.3) v1(26.3,8.3) v1(28.3,138.3) v1(28.3,136.3) v1(28.3,118.3) v1(28.3,116.3) v1(28.3,112.3) v1(28.3,110.3) v1(28.3,100.3) v1(28.3,98.3) v1(28.3,73.99) v1(28.3,69.99) v1(28.3,65.99) v1(29.26,109.15) v1(30.3,138.3) v1(30.3,136.3) v1(30.3,134.3) v1(30.3,132.3) v1(30.3,130.3) v1(30.3,128.3) v1(30.3,126.3) v1(30.3,124.3) v1(30.3,122.3) v1(30.3,120.3) v1(30.3,118.3) v1(30.3,116.3) v1(30.3,75.99) v1(30.3,71.99) v1(30.3,65.99) v1(30.3,52.3) v1(30.3,20.3) v1(30.3,8.3) v1(32.25,43.25) v1(32.2,41.5) v1(32.3,138.3) v1(32.3,136.3) v1(32.3,134.3) v1(32.3,132.3) v1(32.3,130.3) v1(32.3,128.3) v1(32.3,126.3) v1(32.3,124.3) v1(32.3,122.3) v1(32.3,120.3) v1(32.3,118.3) v1(32.3,73.99) v1(32.3,50.3) v1(32.3,28.3) v1(32.3,26.3) v1(32.3,24.3) v1(32.3,22.3) v1(32.3,20.3) v1(32.3,2.3) v1(33.5,115.1) v1(34.1,41.4) v1(34.18,105.64) v1(34.25,43.25) v1(34.3,138.3) v1(34.3,136.3) v1(34.3,134.3) v1(34.3,132.3) v1(34.3,130.3) v1(34.3,128.3) v1(34.3,126.3) v1(34.3,124.3) v1(34.3,122.3) v1(34.3,120.3) v1(34.3,100.3) v1(34.3,67.99) v1(34.3,36.3) v1(34.3,30.3) v1(34.3,28.3) v1(34.3,26.3) v1(34.3,24.3) v1(34.3,22.3) v1(34.3,10.3) v1(34.3,8.3) v1(34.3,6.3) v1(34.3,2.3) v1(34.88,49.9) v1(35.21,116.63) v1(35.21,115.1) v1(35.81,40.09) v1(36.3,136.3) v1(36.3,134.3) v1(36.3,132.3) v1(36.3,130.3) v1(36.3,128.3) v1(36.3,126.3) v1(36.3,124.3) v1(36.3,122.3) v1(36.3,86.3) v1(36.3,84.3) v1(36.3,82.3) v1(36.3,36.3) v1(36.3,10.3) v1(36.3,8.3) v1(37.9,77) v1(38,110.65) v1(38.15,70.2) v1(38.3,136.3) v1(38.3,132.3) v1(38.3,130.3) v1(38.3,128.3) v1(38.3,108.3) v1(38.3,100.3) v1(38.3,98.3) v1(38.3,94.3) v1(38.3,92.3) v1(38.3,86.3) v1(38.3,84.3) v1(38.3,67.99) v1(38.3,2.3) v1(38.85,78) v1(39,70.2) v1(40.3,138.3) v1(40.3,130.3) v1(40.3,128.3) v1(40.3,98.3) v1(40.3,92.3) v1(40.3,67.99) v1(40.3,42.3) v1(40.3,32.3) v1(40.3,18.3) v1(40.3,2.3) v1(41.2,74.73) v1(41.4,78.45) v1(42.05,84.1) v1(42.3,136.3) v1(42.3,128.3) v1(42.3,126.3) v1(42.3,98.3) v1(42.3,92.3) v1(42.3,67.99) v1(42.3,65.99) v1(42.3,63.99) v1(42.3,42.3) v1(42.3,16.3) v1(42.3,2.3) v1(43.05,71.8) v1(44.3,138.3) v1(44.3,136.3) v1(44.3,134.3) v1(44.3,132.3) v1(44.3,130.3) v1(44.3,126.3) v1(44.3,124.3) v1(44.3,116.3) v1(44.3,106.3) v1(44.3,98.3) v1(44.3,96.3) v1(44.3,67.99) v1(44.3,42.3) v1(44.3,30.3) v1(44.3,8.3) v1(44.88,51.9) v1(44.88,49.9) v1(45.11,71.8) v1(45.1,70.15) v1(46.3,138.3) v1(46.3,136.3) v1(46.3,134.3) v1(46.3,132.3) v1(46.3,130.3) v1(46.3,128.3) v1(46.3,118.3) v1(46.3,116.3) v1(46.3,96.3) v1(46.3,67.99) v1(46.3,46.3) v1(46.3,42.3) v1(46.3,32.3) v1(46.3,22.3) v1(46.3,20.3) v1(46.3,2.3) v1(48.3,138.3) v1(48.3,136.3) v1(48.3,134.3) v1(48.3,132.3) v1(48.3,130.3) v1(48.3,128.3) v1(48.3,120.3) v1(48.3,118.3) v1(48.3,116.3) v1(48.3,106.3) v1(48.35,81.5) v1(48.3,50.3) v1(48.3,42.3) v1(48.3,32.3) v1(48.3,30.3) v1(49.4,80.3) v1(50.3,138.3) v1(50.3,136.3) v1(50.3,134.3) v1(50.3,132.3) v1(50.3,130.3) v1(50.3,120.3) v1(50.3,118.3) v1(50.3,116.3) v1(50.3,112.3) v1(50.3,98.3) v1(50.3,58.3) v1(50.3,46.3) v1(50.3,42.3) v1(50.3,30.3) v1(50.3,14.3) v1(50.3,8.3) v1(50.3,2.3) v1(50.45,85.45) v1(50.95,110.2) v1(51.47,24.38) v1(52.3,138.3) v1(52.3,136.3) v1(52.3,134.3) v1(52.3,132.3) v1(52.3,124.3) v1(52.3,120.3) v1(52.3,118.3) v1(52.3,116.3) v1(52.3,112.3) v1(52.3,102.3) v1(52.3,46.3) v1(52.3,42.3) v1(52.3,32.3) v1(52.3,30.3) v1(54.3,138.3) v1(54.3,136.3) v1(54.3,134.3) v1(54.3,126.3) v1(54.3,120.3) v1(54.3,118.3) v1(54.3,116.3) v1(54.3,112.3) v1(54.3,110.3) v1(54.3,104.3) v1(54.3,102.3) v1(54.3,100.3) v1(54.3,98.3) v1(54.3,96.3) v1(54.3,94.3) v1(54.3,92.3) v1(54.3,90.3) v1(54.3,42.3) v1(56.1,73.54) v1(56.3,138.3) v1(56.3,136.3) v1(56.3,128.3) v1(56.3,126.3) v1(56.3,120.3) v1(56.3,118.3) v1(56.3,116.3) v1(56.3,112.3) v1(56.3,110.3) v1(56.3,108.3) v1(56.3,106.3) v1(56.3,104.3) v1(56.3,102.3) v1(56.3,100.3) v1(56.3,98.3) v1(56.3,96.3) v1(56.3,94.3) v1(56.3,92.3) v1(56.3,64.3) v1(56.3,62.3) v1(56.3,60.3) v1(56.3,58.3) v1(56.3,56.3) v1(56.3,44.3) v1(56.3,42.3) v1(56.3,32.3) v1(56.3,30.3) v1(56.3,22.3) v1(56.3,20.3) v1(56.3,18.3) v1(56.3,16.3) v1(56.3,8.3) v1(56.3,6.3) v1(56.3,4.3) v1(56.3,2.3) v1(58.3,138.3) v1(58.3,136.3) v1(58.3,126.3) v1(58.3,118.3) v1(58.3,116.3) v1(58.3,112.3) v1(58.3,110.3) v1(58.3,108.3) v1(58.3,106.3) v1(58.3,104.3) v1(58.3,102.3) v1(58.3,100.3) v1(58.3,98.3) v1(58.3,96.3) v1(58.3,94.3) v1(58.3,92.3) v1(58.3,90.3) v1(58.3,62.3) v1(58.3,60.3) v1(58.3,58.3) v1(58.3,56.3) v1(58.3,42.3) v1(58.3,22.3) v1(58.3,18.3) v1(58.3,14.3) v1(58.3,12.3) v1(58.3,10.3) v1(58.3,6.3) v1(58.3,4.3) v1(58.3,2.3) v1(60.3,138.3) v1(60.3,136.3) v1(60.3,134.3) v1(60.3,128.3) v1(60.3,126.3) v1(60.3,124.3) v1(60.3,122.3) v1(60.3,120.3) v1(60.3,118.3) v1(60.3,116.3) v1(60.3,112.3) v1(60.3,110.3) v1(60.3,108.3) v1(60.3,106.3) v1(60.3,104.3) v1(60.3,102.3) v1(60.3,100.3) v1(60.3,98.3) v1(60.3,96.3) v1(60.3,94.3) v1(60.3,92.3) v1(60.3,90.3) v1(60.3,60.3) v1(60.3,56.3) v1(60.3,46.3) v1(60.3,16.3) v1(60.3,14.3) v1(60.3,12.3) v1(60.3,10.3) v1(60.3,8.3) v1(60.3,2.3) v1(60.45,86.04) v1(60.45,80.04) v1(60.6,37.9) v1(60.62,36.08) v1(62.3,138.3) v1(62.3,136.3) v1(62.3,134.3) v1(62.3,128.3) v1(62.3,126.3) v1(62.3,124.3) v1(62.3,122.3) v1(62.3,120.3) v1(62.3,118.3) v1(62.3,112.3) v1(62.3,110.3) v1(62.3,108.3) v1(62.3,106.3) v1(62.3,104.3) v1(62.3,102.3) v1(62.3,100.3) v1(62.3,98.3) v1(62.3,96.3) v1(62.3,94.3) v1(62.3,92.3) v1(62.3,68.3) v1(62.3,58.3) v1(62.3,56.3) v1(62.3,46.3) v1(62.3,44.3) v1(62.3,22.3) v1(62.3,18.3) v1(62.3,16.3) v1(62.3,14.3) v1(62.3,12.3) v1(62.3,10.3) v1(62.3,8.3) v1(62.3,6.3) v1(62.3,4.3) v1(62.3,2.3) v1(62.45,37.9) v1(62.45,36.08) v1(64.3,138.3) v1(64.3,136.3) v1(64.3,134.3) v1(64.3,128.3) v1(64.3,126.3) v1(64.3,124.3) v1(64.3,122.3) v1(64.3,120.3) v1(64.3,118.3) v1(64.3,102.3) v1(64.3,100.3) v1(64.3,98.3) v1(64.3,96.3) v1(64.3,94.3) v1(64.3,72.3) v1(64.3,70.3) v1(64.3,68.3) v1(64.3,56.3) v1(64.3,46.3) v1(64.3,44.3) v1(64.3,42.3) v1(64.3,32.3) v1(64.3,22.3) v1(64.3,20.3) v1(64.3,18.3) v1(64.3,16.3) v1(64.3,14.3) v1(64.3,12.3) v1(64.3,10.3) v1(64.3,8.3) v1(64.3,4.3) v1(64.3,2.3) v1(64.45,78.04) v1(66.3,138.3) v1(66.3,136.3) v1(66.3,134.3) v1(66.3,128.3) v1(66.3,126.3) v1(66.3,124.3) v1(66.3,122.3) v1(66.3,120.3) v1(66.3,118.3) v1(66.3,100.3) v1(66.3,98.3) v1(66.3,96.3) v1(66.3,94.3) v1(66.3,88.3) v1(66.3,74.3) v1(66.3,72.3) v1(66.3,70.3) v1(66.3,68.3) v1(66.3,66.3) v1(66.3,64.3) v1(66.3,54.3) v1(66.3,46.3) v1(66.3,44.3) v1(66.3,42.3) v1(66.3,40.3) v1(66.3,38.3) v1(66.3,36.3) v1(66.3,34.3) v1(66.3,32.3) v1(66.3,22.3) v1(66.3,20.3) v1(66.3,18.3) v1(66.3,12.3) v1(66.3,10.3) v1(66.3,8.3) v1(66.3,4.3) v1(66.3,2.3) v1(68.3,138.3) v1(68.3,136.3) v1(68.3,126.3) v1(68.3,124.3) v1(68.3,120.3) v1(68.3,118.3) v1(68.3,112.3) v1(68.3,110.3) v1(68.3,108.3) v1(68.3,106.3) v1(68.3,104.3) v1(68.3,100.3) v1(68.3,98.3) v1(68.3,96.3) v1(68.3,94.3) v1(68.3,82.3) v1(68.3,80.3) v1(68.3,78.3) v1(68.3,76.3) v1(68.3,74.3) v1(68.3,70.3) v1(68.3,68.3) v1(68.3,66.3) v1(68.3,64.3) v1(68.3,24.3) v1(68.3,22.3) v1(68.3,20.3) v1(68.3,18.3) v1(68.3,16.3) v1(68.3,12.3) v1(68.3,10.3) v1(68.3,8.3) v1(68.3,6.3) v1(68.3,4.3) v1(68.3,2.3) v1(70.3,138.3) v1(70.3,136.3) v1(70.3,126.3) v1(70.3,118.3) v1(70.3,112.3) v1(70.3,110.3) v1(70.3,108.3) v1(70.3,106.3) v1(70.3,104.3) v1(70.3,100.3) v1(70.3,98.3) v1(70.3,96.3) v1(70.3,94.3) v1(70.3,84.3) v1(70.3,82.3) v1(70.3,78.3) v1(70.3,68.3) v1(70.3,62.3) v1(70.3,26.3) v1(70.3,20.3) v1(70.3,10.3) v1(70.3,8.3) v1(70.3,6.3) v1(70.3,4.3) v1(70.3,2.3) v1(72.3,138.3) v1(72.3,136.3) v1(72.3,134.3) v1(72.3,132.3) v1(72.3,130.3) v1(72.3,128.3) v1(72.3,126.3) v1(72.3,124.3) v1(72.3,122.3) v1(72.3,120.3) v1(72.3,118.3) v1(72.3,116.3) v1(72.3,112.3) v1(72.3,110.3) v1(72.3,108.3) v1(72.3,106.3) v1(72.3,104.3) v1(72.3,100.3) v1(72.3,98.3) v1(72.3,88.3) v1(72.3,84.3) v1(72.3,82.3) v1(72.3,78.3) v1(72.3,74.3) v1(72.3,72.3) v1(72.3,70.3) v1(72.3,62.3) v1(72.3,60.3) v1(72.3,26.3) v1(72.3,24.3) v1(72.3,20.3) v1(72.3,18.3) v1(72.3,14.3) v1(72.3,12.3) v1(72.3,8.3) v1(72.3,6.3) v1(72.3,4.3) v1(72.3,2.3) v1(74.3,138.3) v1(74.3,132.3) v1(74.3,130.3) v1(74.3,128.3) v1(74.3,126.3) v1(74.3,124.3) v1(74.3,122.3) v1(74.3,120.3) v1(74.3,118.3) v1(74.3,116.3) v1(74.3,114.3) v1(74.3,112.3) v1(74.3,110.3) v1(74.3,108.3) v1(74.3,106.3) v1(74.3,104.3) v1(74.3,102.3) v1(74.3,100.3) v1(74.3,98.3) v1(74.3,88.3) v1(74.3,78.3) v1(74.3,72.3) v1(74.3,68.3) v1(74.3,62.3) v1(74.3,56.3) v1(74.3,54.3) v1(74.3,52.3) v1(74.3,50.3) v1(74.3,48.3) v1(74.3,46.3) v1(74.3,44.3) v1(74.3,42.3) v1(74.3,36.3) v1(74.3,32.3) v1(74.3,26.3) v1(74.3,20.3) v1(74.3,14.3) v1(74.3,10.3) v1(74.3,8.3) v1(74.3,2.3) v1(76.3,138.3) v1(76.3,132.3) v1(76.3,130.3) v1(76.3,128.3) v1(76.3,126.3) v1(76.3,124.3) v1(76.3,122.3) v1(76.3,120.3) v1(76.3,118.3) v1(76.3,116.3) v1(76.3,114.3) v1(76.3,112.3) v1(76.3,110.3) v1(76.3,108.3) v1(76.3,106.3) v1(76.3,104.3) v1(76.3,102.3) v1(76.3,100.3) v1(76.3,98.3) v1(76.3,96.3) v1(76.3,92.3) v1(76.3,88.3) v1(76.3,86.3) v1(76.3,82.3) v1(76.3,80.3) v1(76.3,78.3) v1(76.3,76.3) v1(76.3,74.3) v1(76.3,72.3) v1(76.3,70.3) v1(76.3,68.3) v1(76.3,64.3) v1(76.3,62.3) v1(76.3,60.3) v1(76.3,58.3) v1(76.3,56.3) v1(76.3,54.3) v1(76.3,52.3) v1(76.3,50.3) v1(76.3,48.3) v1(76.3,46.3) v1(76.3,44.3) v1(76.3,42.3) v1(76.3,40.3) v1(76.3,38.3) v1(76.3,34.3) v1(76.3,32.3) v1(76.3,28.3) v1(76.3,24.3) v1(76.3,22.3) v1(76.3,20.3) v1(76.3,18.3) v1(76.3,16.3) v1(76.3,12.3) v1(76.3,10.3) v1(76.3,8.3) v1(76.3,2.3) v1(78.3,138.3) v1(78.3,136.3) v1(78.3,134.3) v1(78.3,132.3) v1(78.3,130.3) v1(78.3,128.3) v1(78.3,126.3) v1(78.3,124.3) v1(78.3,122.3) v1(78.3,120.3) v1(78.3,118.3) v1(78.3,116.3) v1(78.3,114.3) v1(78.3,112.3) v1(78.3,110.3) v1(78.3,108.3) v1(78.3,106.3) v1(78.3,104.3) v1(78.3,102.3) v1(78.3,100.3) v1(78.3,98.3) v1(78.3,96.3) v1(78.3,94.3) v1(78.3,92.3) v1(78.3,90.3) v1(78.3,42.3) v1(78.3,40.3) v1(78.3,38.3) v1(78.3,36.3) v1(78.3,34.3) v1(78.3,30.3) v1(78.3,28.3) v1(78.3,26.3) v1(78.3,24.3) v1(78.3,22.3) v1(78.3,18.3) v1(78.3,16.3) v1(78.3,14.3) v1(78.3,12.3) v1(78.3,10.3) v1(78.3,8.3) v1(78.3,6.3) v1(78.3,4.3) v1(78.3,2.3)
